# EasyEDA Pro project Archive.eprj, schematic Schematic2
Board Name: PogramMemory; Create Date: 2026-04-07; Page Name: P1; Project Name: Jarvis; Schematic Name: Schematic2; Update Date: 2026-04-08; Company: EasyEDA.com; Page Size: A4; Version: V1.0
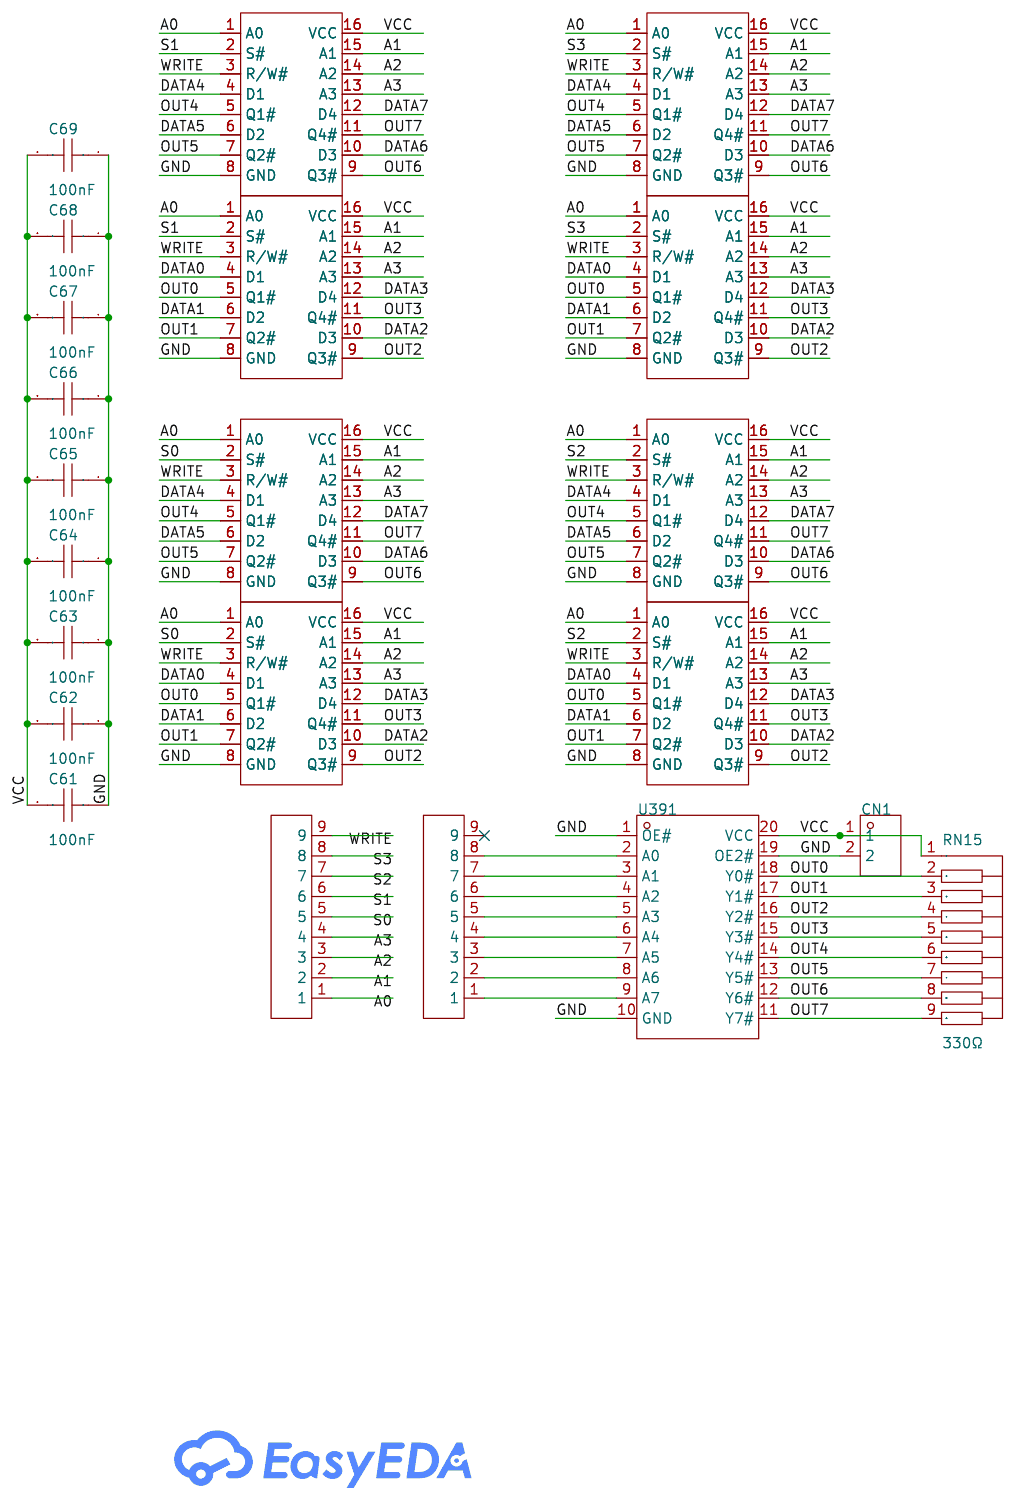
[diagram p2: schematic sheet]

## Parts
C61  100nF  [CAP-TH_L5.0-W2.5-P5.00-D1.0]
C62  100nF  [CAP-TH_L5.0-W2.5-P5.00-D1.0]
C63  100nF  [CAP-TH_L5.0-W2.5-P5.00-D1.0]
C64  100nF  [CAP-TH_L5.0-W2.5-P5.00-D1.0]
C65  100nF  [CAP-TH_L5.0-W2.5-P5.00-D1.0]
C66  100nF  [CAP-TH_L5.0-W2.5-P5.00-D1.0]
C67  100nF  [CAP-TH_L5.0-W2.5-P5.00-D1.0]
C68  100nF  [CAP-TH_L5.0-W2.5-P5.00-D1.0]
C69  100nF  [CAP-TH_L5.0-W2.5-P5.00-D1.0]
CN1  MX7620-7.62-02P-BK01-Cu-S-A  [CONN-TH_2P-P7.62_MX7620-7.62-02P-BK01-CU-S-A]
RN15  330Ω  [RES-ARRAY-TH_9P-P2.54-D1.0]
U370  CD74HC173E  [PDIP-16_L19.2-W6.6-P2.54-LS7.6-BL]
U377  HDR2.54-LI-9P  [HDR-TH_9P-P2.54-V-M]
U378  CD74HC173E  [PDIP-16_L19.2-W6.6-P2.54-LS7.6-BL]
U379  CD74HC173E  [PDIP-16_L19.2-W6.6-P2.54-LS7.6-BL]
U380  CD74HC173E  [PDIP-16_L19.2-W6.6-P2.54-LS7.6-BL]
U381  CD74HC173E  [PDIP-16_L19.2-W6.6-P2.54-LS7.6-BL]
U382  CD74HC173E  [PDIP-16_L19.2-W6.6-P2.54-LS7.6-BL]
U383  CD74HC173E  [PDIP-16_L19.2-W6.6-P2.54-LS7.6-BL]
U384  CD74HC173E  [PDIP-16_L19.2-W6.6-P2.54-LS7.6-BL]
U391  CD74HC540E  [PDIP-20_L25.9-W6.6-P2.54-LS7.9-BL]
U392  HDR2.54-LI-9P  [HDR-TH_9P-P2.54-V-M]

## Library data of the parts
C61-C69 = 178MU0006: Capacitance:100nF Tolerance:±10% Tolerance:±10% Voltage Rating:50V Temperature Coefficient:X7R Pin Spacing:2.54mm; LCSC Part Name: 100nF ±10% 50V; Supplier Part: C5632430; Manufacturer: KNSCHA(科尼盛); Supplier Footprint: 插件,P=2.54mm; JLCPCB Part Class: Extended Part; Datasheet: https://item.szlcsc.com/datasheet/178MU0006/6552585.html; Supplier: LCSC; Tolerance: ±10%; Voltage Rating: 50V; Temperature Coefficient: X7R; Pin Spacing: 2.54mm
CN1 = MX7620-7.62-02P-BK01-Cu-S-A: Barrier Type:2-Side Pitch:7.62mm Number of Positions or Pins:1x2P Mounting Type:Straight Pin Location:Side Mount Number of Pins:2P Number of Rows:1 Number of PINs Per Row:2 Screw Specification:M3 Current Rating:20A Voltage Rating (Max):300V Wire Gauge - A; LCSC Part Name: 7.62mm 1x2P 直插 边脚 排数:1 每排P数:2; Supplier Part: C5188500; Manufacturer: MAX(迈旭); Supplier Footprint: 插件,P=7.62mm; JLCPCB Part Class: Extended Part; Datasheet: https://item.szlcsc.com/datasheet/MX7620-7.62-02P-BK01-Cu-S-A/5862584.html; Supplier: LCSC; Barrier Type: 2-Side; Pitch: 7.62mm; Number of Positions or Pins: 1x2P; Mounting Type: Straight; Pin Location: Side Mount; Number of Pins: 2P; Number of Rows: 1; Number of PINs Per Row: 2; Screw Specification: M3; Current Rating: 20A; Voltage Rating (Max): 300V; Wire Gauge - AWG: 12~22; Wire Gauge - mm2: 2.5; Operating Temperature: -40℃~+105℃; Color: Black
RN15 = RAA09331G: Number of Resistors: Resistance: Tolerance:±2% Tolerance:±2% Power(Watts): Temperature Coefficient:±100ppm/℃ Temperature Coefficient:±100ppm/℃ Number of Pins:; LCSC Part Name: 330Ω ±2%; Supplier Part: C353617; Manufacturer: Monec(鑫汇); Supplier Footprint: SIP-9-2.54mm; JLCPCB Part Class: Extended Part; Datasheet: https://atta.szlcsc.com/upload/public/pdf/source/20190415/C353617_CE0FBC2F670EA1E78594FBF4B85EE317.pdf; Supplier: LCSC; Tolerance: ±2%; Temperature Coefficient: ±100ppm/℃
U370 U378-U384 = CD74HC173E: Type:D-Type Trigger Type:Rising Edge Voltage - Supply:2V~6V Voltage - Supply:2V~6V Clock Frequency:60MHz Function:Reset Number of Elements:1 Number of Bits per Element:4 Output Type:Tri-State Propagation Delay:34ns@6V,50pF Series:74HC Series Current - Out; LCSC Part Name: 三态高速CMOS逻辑四路D型触发器; Supplier Part: C1549968; Manufacturer: TI(德州仪器); Supplier Footprint: PDIP-16; JLCPCB Part Class: Extended Part; Datasheet: https://www.ti.com/cn/lit/gpn/cd74hct173; Supplier: LCSC; Type: D-Type; Trigger Type: Rising Edge; Voltage - Supply: 2V~6V; Clock Frequency: 60MHz; Function: Reset; Number of Elements: 1; Number of Bits per Element: 4; Output Type: Tri-State; Propagation Delay: 34ns@6V,50pF; Series: 74HC Series; Current - Output Low(IOL): 7.8mA; Current - Output High(IOH): 7.8mA; Quiescent Current: 8uA; Input Capacitance: 10pF; Operating Temperature: -55℃~+125℃; Setup Time: 12ns; Hold Time: 3ns
U377 U392 = HDR2.54-LI-9P: Supplier Part: C9900020142; JLCPCB Part Class: Extended Part; Supplier: LCSC
U391 = CD74HC540E: Input type:- output type:Tri-State Voltage - Supply:2V~6V Voltage - Supply:2V~6V Number of Elements:1 Number of Bits per Element:8 Channel Type:- Current - Output Low(IOL):7.8mA Current - Output High(IOH):7.8mA Logic Family:74HC Operating Temperature:-55℃; Supplier Part: C2860475; Manufacturer: TI(德州仪器); Supplier Footprint: PDIP-20; JLCPCB Part Class: Extended Part; Datasheet: https://www.ti.com/cn/lit/gpn/cd74hc540; Supplier: LCSC; output type: Tri-State; Voltage - Supply: 2V~6V; Number of Elements: 1; Number of Bits per Element: 8; Current - Output Low(IOL): 7.8mA; Current - Output High(IOH): 7.8mA; Logic Family: 74HC; Operating Temperature: -55℃~+125℃; Quiescent Current: 160uA; Propagation Delay: 9ns@5V,15pF

## Nets
GND: C61.1 C62.1 C63.1 C64.1 C65.1 C66.1 C67.1 C68.1 C69.1 CN1.2 U370.8(GND) U378.8(GND) U379.8(GND) U380.8(GND) U381.8(GND) U382.8(GND) U383.8(GND) U384.8(GND) U391.1(OE#) U391.10(GND) U391.19(OE2#)
VCC: C61.2 C62.2 C63.2 C64.2 C65.2 C66.2 C67.2 C68.2 C69.2 CN1.1 RN15.1 U370.16(VCC) U378.16(VCC) U379.16(VCC) U380.16(VCC) U381.16(VCC) U382.16(VCC) U383.16(VCC) U384.16(VCC) U391.20(VCC)
A0: U370.1(A0) U377.1 U378.1(A0) U379.1(A0) U380.1(A0) U381.1(A0) U382.1(A0) U383.1(A0) U384.1(A0)
A1: U370.15(A1) U377.2 U378.15(A1) U379.15(A1) U380.15(A1) U381.15(A1) U382.15(A1) U383.15(A1) U384.15(A1)
A2: U370.14(A2) U377.3 U378.14(A2) U379.14(A2) U380.14(A2) U381.14(A2) U382.14(A2) U383.14(A2) U384.14(A2)
A3: U370.13(A3) U377.4 U378.13(A3) U379.13(A3) U380.13(A3) U381.13(A3) U382.13(A3) U383.13(A3) U384.13(A3)
DATA0: U370.4(D1) U379.4(D1) U381.4(D1) U383.4(D1)
DATA1: U370.6(D2) U379.6(D2) U381.6(D2) U383.6(D2)
DATA2: U370.10(D3) U379.10(D3) U381.10(D3) U383.10(D3)
DATA3: U370.12(D4) U379.12(D4) U381.12(D4) U383.12(D4)
DATA4: U378.4(D1) U380.4(D1) U382.4(D1) U384.4(D1)
DATA5: U378.6(D2) U380.6(D2) U382.6(D2) U384.6(D2)
DATA6: U378.10(D3) U380.10(D3) U382.10(D3) U384.10(D3)
DATA7: U378.12(D4) U380.12(D4) U382.12(D4) U384.12(D4)
OUT0: RN15.2 U370.5(Q1#) U379.5(Q1#) U381.5(Q1#) U383.5(Q1#) U391.18(Y0#)
OUT1: RN15.3 U370.7(Q2#) U379.7(Q2#) U381.7(Q2#) U383.7(Q2#) U391.17(Y1#)
OUT2: RN15.4 U370.9(Q3#) U379.9(Q3#) U381.9(Q3#) U383.9(Q3#) U391.16(Y2#)
OUT3: RN15.5 U370.11(Q4#) U379.11(Q4#) U381.11(Q4#) U383.11(Q4#) U391.15(Y3#)
OUT4: RN15.6 U378.5(Q1#) U380.5(Q1#) U382.5(Q1#) U384.5(Q1#) U391.14(Y4#)
OUT5: RN15.7 U378.7(Q2#) U380.7(Q2#) U382.7(Q2#) U384.7(Q2#) U391.13(Y5#)
OUT6: RN15.8 U378.9(Q3#) U380.9(Q3#) U382.9(Q3#) U384.9(Q3#) U391.12(Y6#)
OUT7: RN15.9 U378.11(Q4#) U380.11(Q4#) U382.11(Q4#) U384.11(Q4#) U391.11(Y7#)
S0: U370.2(S#) U377.5 U378.2(S#)
S1: U377.6 U379.2(S#) U380.2(S#)
S2: U377.7 U381.2(S#) U382.2(S#)
S3: U377.8 U383.2(S#) U384.2(S#)
WRITE: U370.3(R/W#) U377.9 U378.3(R/W#) U379.3(R/W#) U380.3(R/W#) U381.3(R/W#) U382.3(R/W#) U383.3(R/W#) U384.3(R/W#)
$1N11886: U391.2(A0) U392.8
$1N11888: U391.3(A1) U392.7
$1N11890: U391.4(A2) U392.6
$1N11892: U391.5(A3) U392.5
$1N11894: U391.6(A4) U392.4
$1N11896: U391.7(A5) U392.3
$1N11898: U391.8(A6) U392.2
$1N11900: U391.9(A7) U392.1

Not connected (* = marked no-connect by the designer): U392 9*
